# EasyEDA Pro project Chessboards.epro, board Diagonal (continued)
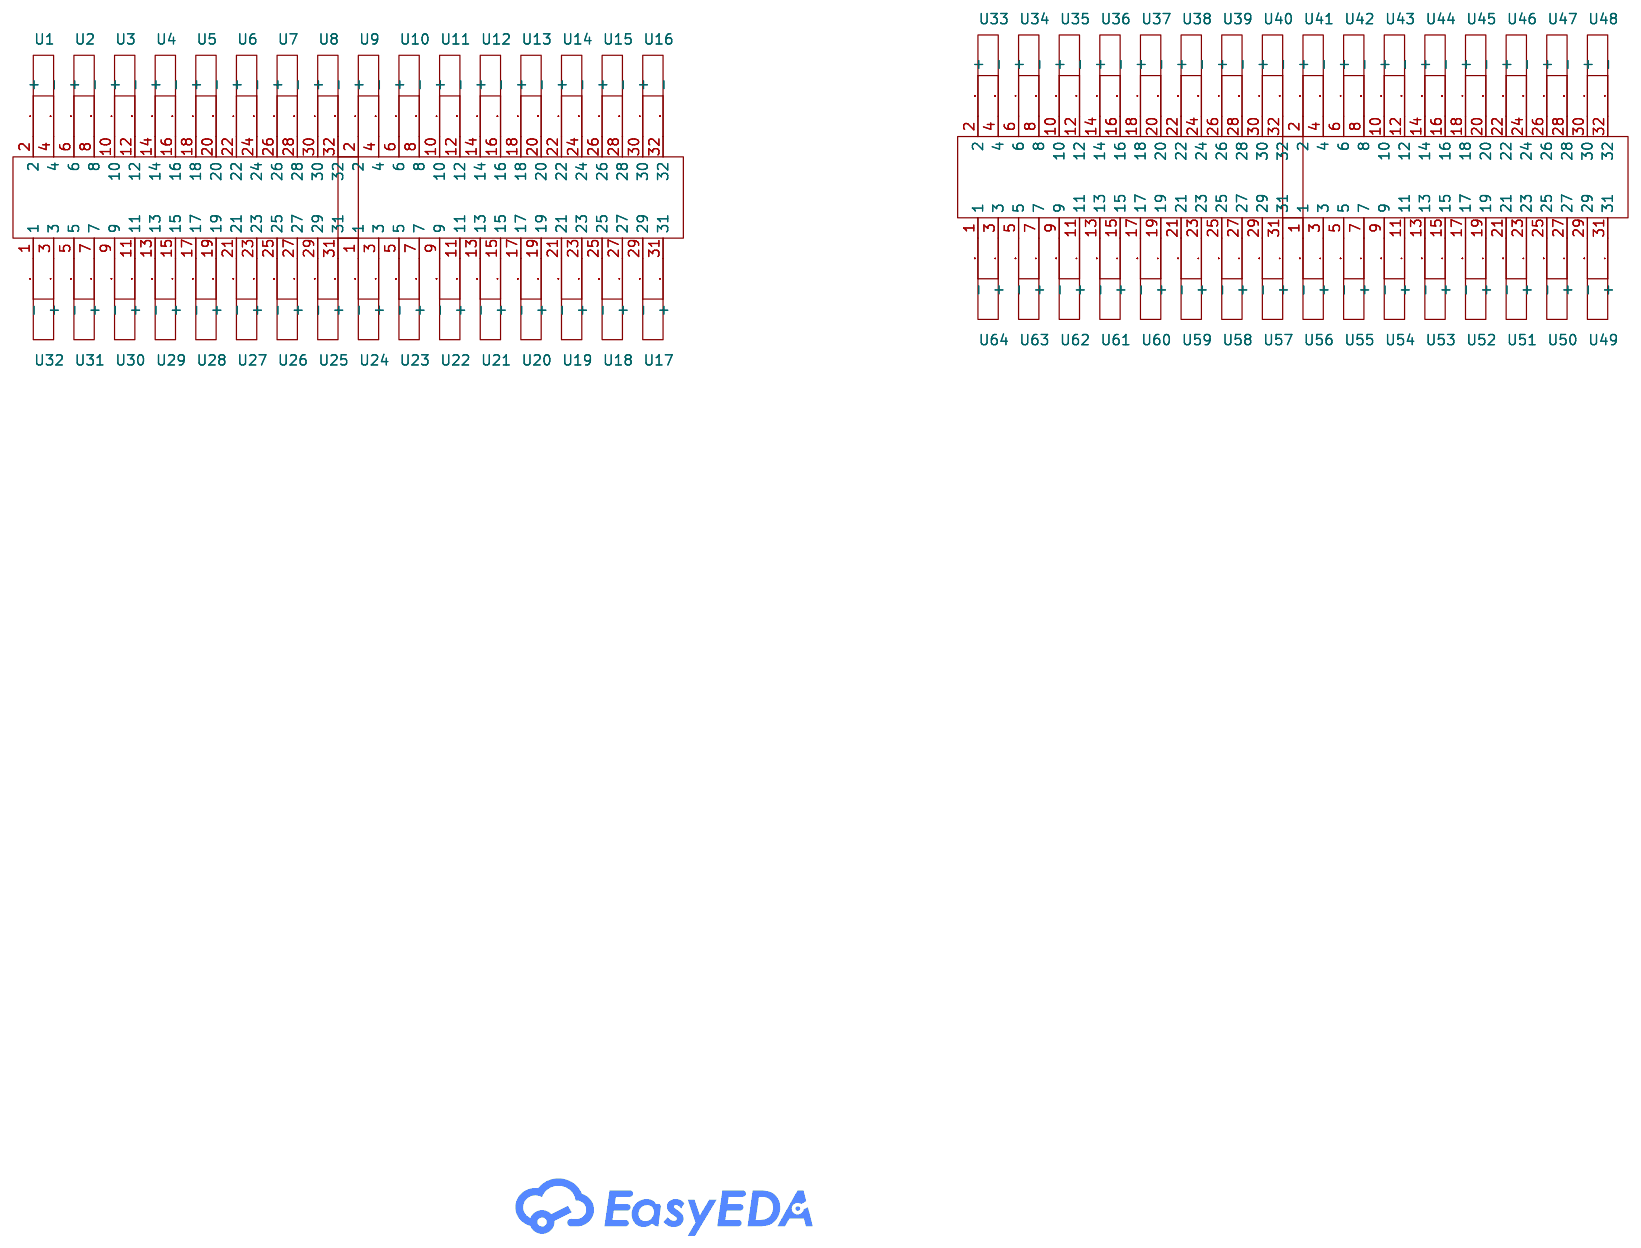
[diagram p0: schematic sheet]
## Routing (per net, layer and track width the routed paths; a pad name or vN(x,y) marks a point on that pad's centre or on a via; arc(x,y) is an arc through that point) (continued)
v1(252.22,52.21) v1(252.22,52.21) v1(252.22,52.21) v1(252.31,408.02) v1(252.31,408.02) v1(252.31,408.02) v1(252.31,408.02) v1(252.33,408.02) v1(252.33,408.02) v1(252.31,407.02) v1(252.31,407.02) v1(252.31,407.02) v1(252.31,407.02) v1(252.33,407.02) v1(252.33,407.02) v1(253.22,53.21) v1(253.22,53.21) v1(253.22,53.21) v1(253.25,52.21) v1(253.22,52.21) v1(253.22,52.21) v1(253.22,52.21) v1(253.31,408.02) v1(253.31,408.02) v1(253.31,408.02) v1(253.31,408.02) v1(253.33,408.02) v1(253.33,408.02) v1(253.31,407.02) v1(253.31,407.02) v1(253.31,407.02) v1(253.31,407.02) v1(253.33,407.02) v1(253.33,407.02) v1(254.22,53.21) v1(254.22,53.21) v1(254.22,53.21) v1(254.25,52.21) v1(254.22,52.21) v1(254.22,52.21) v1(254.22,52.21) v1(254.31,408.02) v1(254.31,408.02) v1(254.31,408.02) v1(254.31,408.02) v1(254.33,408.02) v1(254.33,408.02) v1(254.31,407.02) v1(254.31,407.02) v1(254.31,407.02) v1(254.31,407.02) v1(254.33,407.02) v1(254.33,407.02) v1(255.22,53.21) v1(255.22,53.21) v1(255.22,53.21) v1(255.25,52.21) v1(255.22,52.21) v1(255.22,52.21) v1(255.22,52.21) v1(255.31,408.02) v1(255.31,408.02) v1(255.31,408.02) v1(255.31,408.02) v1(255.33,408.02) v1(255.33,408.02) v1(255.31,407.02) v1(255.31,407.02) v1(255.31,407.02) v1(255.31,407.02) v1(255.33,407.02) v1(255.33,407.02) v1(256.34,408.02) v1(256.34,408.02) v1(256.31,408.02) v1(256.31,408.02) v1(256.31,408.02) v1(256.31,408.02) v1(256.34,407.02) v1(256.34,407.02) v1(256.31,407.02) v1(256.31,407.02) v1(256.31,407.02) v1(256.31,407.02) v1(257.34,408.02) v1(257.34,408.02) v1(257.31,408.02) v1(257.31,408.02) v1(257.31,408.02) v1(257.31,408.02) v1(257.34,407.02) v1(257.34,407.02) v1(257.31,407.02) v1(257.31,407.02) v1(257.31,407.02) v1(257.31,407.02) v1(258.34,408.02) v1(258.34,408.02) v1(258.31,408.02) v1(258.31,408.02) v1(258.31,408.02) v1(258.31,408.02) v1(258.34,407.02) v1(258.34,407.02) v1(258.31,407.02) v1(258.31,407.02) v1(258.31,407.02) v1(258.31,407.02) v1(259.34,408.02) v1(259.34,408.02) v1(259.31,408.02) v1(259.31,408.02) v1(259.31,408.02) v1(259.31,408.02) v1(259.34,407.02) v1(259.34,407.02) v1(259.31,407.02) v1(259.31,407.02) v1(259.31,407.02) v1(259.31,407.02) v1(260.31,408.02) v1(260.31,408.02) v1(260.31,408.02) v1(260.31,408.02) v1(260.34,408.02) v1(260.34,408.02) v1(260.31,407.02) v1(260.31,407.02) v1(260.31,407.02) v1(260.31,407.02) v1(260.34,407.02) v1(260.34,407.02) v1(261.31,408.02) v1(261.31,408.02) v1(261.31,408.02) v1(261.31,408.02) v1(261.34,408.02) v1(261.34,408.02) v1(261.31,407.02) v1(261.31,407.02) v1(261.31,407.02) v1(261.31,407.02) v1(261.34,407.02) v1(261.34,407.02) v1(262.31,408.02) v1(262.31,408.02) v1(262.31,408.02) v1(262.31,408.02) v1(262.34,408.02) v1(262.34,408.02) v1(262.31,407.02) v1(262.31,407.02) v1(262.31,407.02) v1(262.31,407.02) v1(262.34,407.02) v1(262.34,407.02) v1(263.31,408.02) v1(263.31,408.02) v1(263.31,408.02) v1(263.31,408.02) v1(263.34,408.02) v1(263.34,408.02) v1(263.31,407.02) v1(263.31,407.02) v1(263.31,407.02) v1(263.31,407.02) v1(263.34,407.02) v1(263.34,407.02) v1(279.63,53.21) v1(279.63,53.21) v1(279.65,53.21) v1(279.65,53.21) v1(279.63,52.21) v1(279.63,52.21) v1(279.65,52.21) v1(279.65,52.21) v1(280.63,53.21) v1(280.63,53.21) v1(280.65,53.21) v1(280.65,53.21) v1(280.63,52.21) v1(280.63,52.21) v1(280.65,52.21) v1(280.65,52.21) v1(281.63,53.21) v1(281.63,53.21) v1(281.65,53.21) v1(281.65,53.21) v1(281.63,52.21) v1(281.63,52.21) v1(281.65,52.21) v1(281.65,52.21) v1(282.63,53.21) v1(282.63,53.21) v1(282.65,53.21) v1(282.65,53.21) v1(282.63,52.21) v1(282.63,52.21) v1(282.65,52.21) v1(282.65,52.21) v1(283.65,53.21) v1(283.63,53.21) v1(283.63,53.21) v1(283.65,53.2) v1(283.65,52.21) v1(283.63,52.21) v1(283.63,52.21) v1(283.65,52.2) v1(284.65,53.21) v1(284.63,53.21) v1(284.63,53.21) v1(284.65,53.2) v1(284.65,52.21) v1(284.63,52.21) v1(284.63,52.21) v1(284.65,52.2) v1(285.65,53.21) v1(285.63,53.21) v1(285.63,53.21) v1(285.65,53.2) v1(285.65,52.21) v1(285.63,52.21) v1(285.63,52.21) v1(285.65,52.2) v1(286.65,53.21) v1(286.63,53.21) v1(286.63,53.21) v1(286.65,53.2) v1(286.65,52.21) v1(286.63,52.21) v1(286.63,52.21) v1(286.65,52.2) v1(287.63,53.21) v1(287.63,53.21) v1(287.66,53.21) v1(287.66,53.21) v1(287.63,52.21) v1(287.63,52.21) v1(287.66,52.21) v1(287.66,52.21) v1(287.74,408.02) v1(287.74,408.02) v1(287.74,408.02) v1(287.74,407.02) v1(287.74,407.02) v1(287.74,407.02) v1(288.63,53.21) v1(288.63,53.21) v1(288.66,53.21) v1(288.66,53.21) v1(288.63,52.21) v1(288.63,52.21) v1(288.66,52.21) v1(288.66,52.21) v1(288.74,408.02) v1(288.74,408.02) v1(288.74,408.02) v1(288.74,407.02) v1(288.74,407.02) v1(288.74,407.02) v1(289.63,53.21) v1(289.63,53.21) v1(289.66,53.21) v1(289.66,53.21) v1(289.63,52.21) v1(289.63,52.21) v1(289.66,52.21) v1(289.66,52.21) v1(289.74,408.02) v1(289.74,408.02) v1(289.74,408.02) v1(289.74,407.02) v1(289.74,407.02) v1(289.74,407.02) v1(290.63,53.21) v1(290.63,53.21) v1(290.66,53.21) v1(290.66,53.21) v1(290.63,52.21) v1(290.63,52.21) v1(290.66,52.21) v1(290.66,52.21) v1(290.74,408.02) v1(290.74,408.02) v1(290.74,408.02) v1(290.74,407.02) v1(290.74,407.02) v1(290.74,407.02) v1(291.63,53.21) v1(291.63,53.21) v1(291.66,53.2) v1(291.63,52.21) v1(291.63,52.21) v1(291.66,52.2) v1(291.74,408.03) v1(291.72,408.02) v1(291.72,408.02) v1(291.72,408.02) v1(291.74,408.02) v1(291.74,408.02) v1(291.74,407.03) v1(291.72,407.02) v1(291.72,407.02) v1(291.72,407.02) v1(291.74,407.02) v1(291.74,407.02) v1(292.63,53.21) v1(292.63,53.21) v1(292.66,53.2) v1(292.63,52.21) v1(292.63,52.21) v1(292.66,52.2) v1(292.74,408.03) v1(292.72,408.02) v1(292.72,408.02) v1(292.72,408.02) v1(292.74,408.02) v1(292.74,408.02) v1(292.74,407.03) v1(292.72,407.02) v1(292.72,407.02) v1(292.72,407.02) v1(292.74,407.02) v1(292.74,407.02) v1(293.63,53.21) v1(293.63,53.21) v1(293.66,53.2) v1(293.63,52.21) v1(293.63,52.21) v1(293.66,52.2) v1(293.74,408.03) v1(293.72,408.02) v1(293.72,408.02) v1(293.72,408.02) v1(293.74,408.02) v1(293.74,408.02) v1(293.74,407.03) v1(293.72,407.02) v1(293.72,407.02) v1(293.72,407.02) v1(293.74,407.02) v1(293.74,407.02) v1(294.63,53.21) v1(294.63,53.21) v1(294.66,53.2) v1(294.63,52.21) v1(294.63,52.21) v1(294.66,52.2) v1(294.74,408.03) v1(294.72,408.02) v1(294.72,408.02) v1(294.72,408.02) v1(294.74,408.02) v1(294.74,408.02) v1(294.74,407.03) v1(294.72,407.02) v1(294.72,407.02) v1(294.72,407.02) v1(294.74,407.02) v1(294.74,407.02) v1(295.74,408.02) v1(295.74,408.02) v1(295.74,408.02) v1(295.72,408.02) v1(295.72,408.02) v1(295.72,408.02) v1(295.74,407.02) v1(295.74,407.02) v1(295.74,407.02) v1(295.72,407.02) v1(295.72,407.02) v1(295.72,407.02) v1(296.74,408.02) v1(296.74,408.02) v1(296.74,408.02) v1(296.72,408.02) v1(296.72,408.02) v1(296.72,408.02) v1(296.74,407.02) v1(296.74,407.02) v1(296.74,407.02) v1(296.72,407.02) v1(296.72,407.02) v1(296.72,407.02) v1(297.74,408.02) v1(297.74,408.02) v1(297.74,408.02) v1(297.72,408.02) v1(297.72,408.02) v1(297.72,408.02) v1(297.74,407.02) v1(297.74,407.02) v1(297.74,407.02) v1(297.72,407.02) v1(297.72,407.02) v1(297.72,407.02) v1(298.74,408.02) v1(298.74,408.02) v1(298.74,408.02) v1(298.72,408.02) v1(298.72,408.02) v1(298.72,408.02) v1(298.74,407.02) v1(298.74,407.02) v1(298.74,407.02) v1(298.72,407.02) v1(298.72,407.02) v1(298.72,407.02) v1(299.74,408.03) v1(299.72,408.02) v1(299.72,408.02) v1(299.72,408.02) v1(299.74,408.02) v1(299.74,408.02) v1(299.74,407.03) v1(299.72,407.02) v1(299.72,407.02) v1(299.72,407.02) v1(299.74,407.02) v1(299.74,407.02) v1(300.74,408.03) v1(300.72,408.02) v1(300.72,408.02) v1(300.72,408.02) v1(300.74,408.02) v1(300.74,408.02) v1(300.74,407.03) v1(300.72,407.02) v1(300.72,407.02) v1(300.72,407.02) v1(300.74,407.02) v1(300.74,407.02) v1(301.74,408.03) v1(301.72,408.02) v1(301.72,408.02) v1(301.72,408.02) v1(301.74,408.02) v1(301.74,408.02) v1(301.74,407.03) v1(301.72,407.02) v1(301.72,407.02) v1(301.72,407.02) v1(301.74,407.02) v1(301.74,407.02) v1(302.74,408.03) v1(302.72,408.02) v1(302.72,408.02) v1(302.72,408.02) v1(302.74,408.02) v1(302.74,408.02) v1(302.74,407.03) v1(302.72,407.02) v1(302.72,407.02) v1(302.72,407.02) v1(302.74,407.02) v1(302.74,407.02) v1(319.06,53.22) v1(319.04,53.21) v1(319.06,53.21) v1(319.08,53.2) v1(319.06,52.22) v1(319.04,52.21) v1(319.06,52.21) v1(319.08,52.2) v1(320.06,53.22) v1(320.04,53.21) v1(320.06,53.21) v1(320.08,53.2) v1(320.06,52.22) v1(320.04,52.21) v1(320.06,52.21) v1(320.08,52.2) v1(321.06,53.22) v1(321.04,53.21) v1(321.06,53.21) v1(321.08,53.2) v1(321.06,52.22) v1(321.04,52.21) v1(321.06,52.21) v1(321.08,52.2) v1(322.06,53.22) v1(322.04,53.21) v1(322.06,53.21) v1(322.08,53.2) v1(322.06,52.22) v1(322.04,52.21) v1(322.06,52.21) v1(322.08,52.2) v1(323.06,53.21) v1(323.04,53.21) v1(323.08,53.21) v1(323.06,53.2) v1(323.06,52.21) v1(323.04,52.21) v1(323.08,52.21) v1(323.06,52.2) v1(324.06,53.21) v1(324.04,53.21) v1(324.08,53.21) v1(324.06,53.2) v1(324.06,52.21) v1(324.04,52.21) v1(324.08,52.21) v1(324.06,52.2) v1(325.06,53.21) v1(325.04,53.21) v1(325.08,53.21) v1(325.06,53.2) v1(325.06,52.21) v1(325.04,52.21) v1(325.08,52.21) v1(325.06,52.2) v1(326.06,53.21) v1(326.04,53.21) v1(326.08,53.21) v1(326.06,53.2) v1(326.06,52.21) v1(326.04,52.21) v1(326.08,52.21) v1(326.06,52.2) v1(327.06,53.22) v1(327.04,53.21) v1(327.06,53.21) v1(327.09,53.2) v1(327.06,52.22) v1(327.04,52.21) v1(327.06,52.21) v1(327.09,52.2) v1(327.17,408.03) v1(327.15,408.02) v1(327.15,408.02) v1(327.15,408.01) v1(327.17,407.03) v1(327.15,407.02) v1(327.15,407.02) v1(327.15,407.01) v1(328.06,53.22) v1(328.04,53.21) v1(328.06,53.21) v1(328.09,53.2) v1(328.06,52.22) v1(328.04,52.21) v1(328.06,52.21) v1(328.09,52.2) v1(328.17,408.03) v1(328.15,408.02) v1(328.15,408.02) v1(328.15,408.01) v1(328.17,407.03) v1(328.15,407.02) v1(328.15,407.02) v1(328.15,407.01) v1(329.06,53.22) v1(329.04,53.21) v1(329.06,53.21) v1(329.09,53.2) v1(329.06,52.22) v1(329.04,52.21) v1(329.06,52.21) v1(329.09,52.2) v1(329.17,408.03) v1(329.15,408.02) v1(329.15,408.02) v1(329.15,408.01) v1(329.17,407.03) v1(329.15,407.02) v1(329.15,407.02) v1(329.15,407.01) v1(330.06,53.22) v1(330.04,53.21) v1(330.06,53.21) v1(330.09,53.2) v1(330.06,52.22) v1(330.04,52.21) v1(330.06,52.21) v1(330.09,52.2) v1(330.17,408.03) v1(330.15,408.02) v1(330.15,408.02) v1(330.15,408.01) v1(330.17,407.03) v1(330.15,407.02) v1(330.15,407.02) v1(330.15,407.01) v1(331.06,53.21) v1(331.04,53.21) v1(331.09,53.21) v1(331.06,53.2) v1(331.06,52.21) v1(331.04,52.21) v1(331.09,52.21) v1(331.06,52.2) v1(331.15,408.03) v1(331.17,408.02) v1(331.12,408.02) v1(331.12,408.02) v1(331.15,408.02) v1(331.15,408.02) v1(331.15,407.03) v1(331.17,407.02) v1(331.12,407.02) v1(331.12,407.02) v1(331.15,407.02) v1(331.15,407.02) v1(332.06,53.21) v1(332.04,53.21) v1(332.09,53.21) v1(332.06,53.2) v1(332.06,52.21) v1(332.09,52.21) v1(332.04,52.21) v1(332.06,52.2) v1(332.15,408.03) v1(332.17,408.02) v1(332.12,408.02) v1(332.12,408.02) v1(332.15,408.02) v1(332.15,408.02) v1(332.15,407.03) v1(332.17,407.02) v1(332.12,407.02) v1(332.12,407.02) v1(332.15,407.02) v1(332.15,407.02) v1(333.06,53.21) v1(333.04,53.21) v1(333.09,53.21) v1(333.06,53.2) v1(333.06,52.21) v1(333.04,52.21) v1(333.09,52.21) v1(333.06,52.2) v1(333.15,408.03) v1(333.17,408.02) v1(333.12,408.02) v1(333.12,408.02) v1(333.15,408.02) v1(333.15,408.02) v1(333.15,407.03) v1(333.17,407.02) v1(333.12,407.02) v1(333.12,407.02) v1(333.15,407.02) v1(333.15,407.02) v1(334.06,53.21) v1(334.04,53.21) v1(334.09,53.21) v1(334.06,53.2) v1(334.06,52.21) v1(334.04,52.21) v1(334.09,52.21) v1(334.06,52.2) v1(334.15,408.03) v1(334.17,408.02) v1(334.12,408.02) v1(334.12,408.02) v1(334.15,408.02) v1(334.15,408.02) v1(334.15,407.03) v1(334.17,407.02) v1(334.12,407.02) v1(334.12,407.02) v1(334.15,407.02) v1(334.15,407.02) v1(335.17,408.03) v1(335.15,408.02) v1(335.15,408.02) v1(335.13,408.02) v1(335.13,408.02) v1(335.15,408.01) v1(335.17,407.03) v1(335.15,407.02) v1(335.15,407.02) v1(335.13,407.02) v1(335.13,407.02) v1(335.15,407.01) v1(336.17,408.03) v1(336.15,408.02) v1(336.15,408.02) v1(336.13,408.02) v1(336.13,408.02) v1(336.15,408.01) v1(336.17,407.03) v1(336.15,407.02) v1(336.15,407.02) v1(336.13,407.02) v1(336.13,407.02) v1(336.15,407.01) v1(337.17,408.03) v1(337.15,408.02) v1(337.15,408.02) v1(337.13,408.02) v1(337.13,408.02) v1(337.15,408.01) v1(337.17,407.03) v1(337.15,407.02) v1(337.15,407.02) v1(337.13,407.02) v1(337.13,407.02) v1(337.15,407.01) v1(338.17,408.03) v1(338.15,408.02) v1(338.15,408.02) v1(338.13,408.02) v1(338.13,408.02) v1(338.15,408.01) v1(338.17,407.03) v1(338.15,407.02) v1(338.15,407.02) v1(338.13,407.02) v1(338.13,407.02) v1(338.15,407.01) v1(339.15,408.03) v1(339.13,408.02) v1(339.13,408.02) v1(339.17,408.02) v1(339.15,408.02) v1(339.15,408.02) v1(339.15,407.03) v1(339.13,407.02) v1(339.13,407.02) v1(339.17,407.02) v1(339.15,407.02) v1(339.15,407.02) v1(340.15,408.03) v1(340.17,408.02) v1(340.13,408.02) v1(340.13,408.02) v1(340.15,408.02) v1(340.15,408.02) v1(340.15,407.03) v1(340.13,407.02) v1(340.17,407.02) v1(340.13,407.02) v1(340.15,407.02) v1(340.15,407.02) v1(341.15,408.03) v1(341.13,408.02) v1(341.13,408.02) v1(341.17,408.02) v1(341.15,408.02) v1(341.15,408.02) v1(341.15,407.03) v1(341.17,407.02) v1(341.13,407.02) v1(341.13,407.02) v1(341.15,407.02) v1(341.15,407.02) v1(342.15,408.03) v1(342.13,408.02) v1(342.17,408.02) v1(342.13,408.02) v1(342.15,408.02) v1(342.15,408.02) v1(342.15,407.03) v1(342.17,407.02) v1(342.13,407.02) v1(342.13,407.02) v1(342.15,407.02) v1(342.15,407.02) v1(362.48,53.22) v1(362.48,53.21) v1(362.48,52.22) v1(362.48,52.21) v1(363.48,53.22) v1(363.48,53.21) v1(363.48,52.22) v1(363.48,52.21) v1(364.48,53.22) v1(364.48,53.21) v1(364.48,52.22) v1(364.48,52.21) v1(365.48,53.22) v1(365.48,53.21) v1(365.48,52.22) v1(365.48,52.21) v1(366.49,53.21) v1(366.49,53.21) v1(366.49,52.21) v1(366.49,52.21) v1(367.49,53.21) v1(367.49,53.21) v1(367.49,52.21) v1(367.49,52.21) v1(368.49,53.21) v1(368.49,53.21) v1(368.49,52.21) v1(368.49,52.21) v1(369.49,53.21) v1(369.49,53.21) v1(369.49,52.21) v1(369.49,52.21) v1(370.49,53.22) v1(370.49,53.21) v1(370.49,52.22) v1(370.49,52.21) v1(371.49,53.22) v1(371.49,53.21) v1(371.49,52.22) v1(371.49,52.21) v1(371.53,53.16) v1(371.53,53.16) v1(371.53,52.16) v1(371.53,52.16) v1(372.49,53.22) v1(372.49,53.21) v1(372.49,52.22) v1(372.49,52.21) v1(372.53,53.16) v1(372.53,53.16) v1(372.53,52.16) v1(372.53,52.16) v1(373.49,53.22) v1(373.49,53.21) v1(373.49,52.22) v1(373.49,52.21) v1(373.53,53.16) v1(373.53,53.16) v1(373.53,52.16) v1(373.53,52.16) v1(397.89,53.21) v1(397.91,53.21) v1(398.89,53.21) v1(398.91,53.21) v1(399.89,53.21) v1(399.91,53.21) v1(400.89,53.21) v1(400.91,53.21) v1(401.89,53.21) v1(401.91,53.21) v1(402.89,53.21) v1(402.91,53.21) v1(403.89,53.21) v1(403.91,53.21) v1(404.89,53.21) v1(404.91,53.21) v1(405.9,53.21) v1(405.92,53.21) v1(406.9,53.21) v1(406.92,53.21) v1(407.9,53.21) v1(407.92,53.21) v1(408.9,53.21) v1(408.92,53.21) v1(409.9,53.21) v1(410.9,53.21) v1(411.9,53.21) v1(412.9,53.21) v1(437.32,53.21) v1(437.32,53.21) v1(437.32,52.21) v1(437.32,52.21) v1(438.32,53.21) v1(438.32,53.21) v1(438.32,52.21) v1(438.32,52.21) v1(439.32,53.21) v1(439.32,53.21) v1(439.32,52.21) v1(439.32,52.21) v1(440.32,53.21) v1(440.32,53.21) v1(440.32,52.21) v1(440.32,52.21) v1(441.32,53.21) v1(441.32,53.2) v1(441.32,52.21) v1(441.32,52.2) v1(442.32,53.21) v1(442.32,53.2) v1(442.32,52.21) v1(442.32,52.2) v1(443.32,53.21) v1(443.32,53.2) v1(443.32,52.21) v1(443.32,52.2) v1(444.32,53.21) v1(444.32,53.2) v1(444.32,52.21) v1(444.32,52.2) v1(445.33,53.21) v1(445.33,53.21) v1(445.33,52.21) v1(445.33,52.21) v1(446.33,53.21) v1(446.33,53.21) v1(446.33,52.21) v1(446.33,52.21) v1(447.33,53.21) v1(447.33,53.21) v1(447.33,52.21) v1(447.33,52.21) v1(448.33,53.21) v1(448.33,53.21) v1(448.33,52.21) v1(448.33,52.21) v1(449.33,53.2) v1(449.33,52.2) v1(450.33,53.2) v1(450.33,52.2) v1(451.33,53.2) v1(451.33,52.2) v1(452.33,53.2) v1(452.33,52.2) v2(44.26,389.1) v2(45.83,368.8) v2(49.29,389.13) v2(49.98,388.49) v2(64.9,368.28) v2(66.16,388.6) v2(83.7,389.1) v2(85.26,368.8) v2(88.73,389.13) v2(89.41,388.49) v2(104.34,368.28) v2(105.59,388.6) v2(123.11,389.1) v2(124.67,368.8) v2(128.14,389.13) v2(128.82,388.49) v2(143.75,368.28) v2(145,388.6) v2(162.52,389.08) v2(164.08,368.78) v2(167.54,389.1) v2(168.23,388.47) v2(183.16,368.25) v2(184.41,388.57) v2(201.95,389.1) v2(203.51,368.8) v2(206.98,389.13) v2(207.66,388.49) v2(222.59,368.28) v2(223.84,388.6) v2(241.38,389.1) v2(242.95,368.8) v2(246.41,389.13) v2(247.1,388.49) v2(262.02,368.28) v2(263.28,388.6) v2(280.79,389.1) v2(282.36,368.8) v2(285.82,389.13) v2(286.51,388.49) v2(295.41,476.38) v2(296.68,476.38) v2(297.95,476.38) v2(300.5,476.38) v2(301.43,368.28) v2(301.78,476.38) v2(302.69,388.6) v2(303.05,476.38) v2(304.32,476.38) v2(310.69,476.38) v2(311.97,476.38) v2(320.2,389.08) v2(321.76,368.78) v2(325.23,389.1) v2(325.91,388.47) v2(340.84,368.25) v2(342.09,388.57) v2(359.62,389.1) v2(361.18,368.8) v2(364.65,389.13) v2(365.33,388.49) v2(380.26,368.28) v2(381.51,388.6) v2(399.05,389.1) v2(400.62,368.8) v2(404.08,389.13) v2(404.77,388.49) v2(419.69,368.28) v2(420.95,388.6) v2(438.46,389.1) v2(440.03,368.8) v2(443.49,389.13) v2(444.18,388.49) v2(459.1,368.28) v2(460.36,388.6)
